# EAGLE board Resistor_Resistor (EAGLE 8.3.0), part 17 of 32
## Placement (x,y rotation side) (continued)
R20483  10K  [0201]  149.71,51.26 0 top
R20484  10K  [0201]  149.71,51.87 0 top
R20485  10K  [0201]  149.71,52.48 0 top
R20486  10K  [0201]  149.71,53.09 0 top
R20487  10K  [0201]  149.71,53.7 0 top
R20488  10K  [0201]  149.71,54.31 0 top
R20489  10K  [0201]  149.71,54.91 0 top
R20490  10K  [0201]  149.71,55.52 0 top
R20491  10K  [0201]  149.71,56.13 0 top
R20492  10K  [0201]  149.71,56.74 0 top
R20493  10K  [0201]  149.71,57.35 0 top
R20494  10K  [0201]  149.71,57.96 0 top
R20495  10K  [0201]  149.71,58.57 0 top
R20496  10K  [0201]  149.71,59.18 0 top
R20497  10K  [0201]  149.71,59.79 0 top
R20498  10K  [0201]  149.71,60.4 0 top
R20499  10K  [0201]  149.71,61.01 0 top
R20500  10K  [0201]  149.71,61.62 0 top
R20501  10K  [0201]  149.71,62.23 0 top
R20502  10K  [0201]  149.71,62.84 0 top
R20503  10K  [0201]  149.71,63.45 0 top
R20504  10K  [0201]  149.71,64.06 0 top
R20505  10K  [0201]  149.71,64.67 0 top
R20506  10K  [0201]  149.71,65.28 0 top
R20507  10K  [0201]  149.71,65.89 0 top
R20508  10K  [0201]  149.71,66.5 0 top
R20509  10K  [0201]  149.71,67.11 0 top
R20510  10K  [0201]  149.71,67.72 0 top
R20511  10K  [0201]  149.71,68.33 0 top
R20512  10K  [0201]  149.71,68.94 0 top
R20513  10K  [0201]  149.71,69.55 0 top
R20514  10K  [0201]  149.71,70.15 0 top
R20515  10K  [0201]  149.71,70.76 0 top
R20516  10K  [0201]  149.71,71.37 0 top
R20517  10K  [0201]  149.71,71.98 0 top
R20518  10K  [0201]  149.71,72.59 0 top
R20519  10K  [0201]  149.71,73.2 0 top
R20520  10K  [0201]  149.71,73.81 0 top
R20521  10K  [0201]  149.71,74.42 0 top
R20522  10K  [0201]  149.71,75.03 0 top
R20523  10K  [0201]  149.71,75.64 0 top
R20524  10K  [0201]  149.71,76.25 0 top
R20525  10K  [0201]  149.71,76.86 0 top
R20526  10K  [0201]  149.71,77.47 0 top
R20527  10K  [0201]  149.71,78.08 0 top
R20528  10K  [0201]  149.71,78.69 0 top
R20529  10K  [0201]  149.71,79.3 0 top
R20530  10K  [0201]  149.71,79.91 0 top
R20531  10K  [0201]  149.71,80.52 0 top
R20532  10K  [0201]  149.71,81.13 0 top
R20533  10K  [0201]  149.71,81.74 0 top
R20534  10K  [0201]  149.71,82.35 0 top
R20535  10K  [0201]  149.71,82.96 0 top
R20536  10K  [0201]  149.71,83.57 0 top
R20537  10K  [0201]  149.71,84.18 0 top
R20538  10K  [0201]  149.71,84.79 0 top
R20539  10K  [0201]  149.71,85.39 0 top
R20540  10K  [0201]  149.71,86 0 top
R20541  10K  [0201]  149.71,86.61 0 top
R20542  10K  [0201]  149.71,87.22 0 top
R20543  10K  [0201]  149.71,87.83 0 top
R20544  10K  [0201]  149.71,88.44 0 top
R20545  10K  [0201]  149.71,89.05 0 top
R20546  10K  [0201]  149.71,89.66 0 top
R20547  10K  [0201]  149.71,90.27 0 top
R20548  10K  [0201]  149.71,90.88 0 top
R20549  10K  [0201]  149.71,91.49 0 top
R20550  10K  [0201]  149.71,92.1 0 top
R20551  10K  [0201]  149.71,92.71 0 top
R20552  10K  [0201]  149.71,93.32 0 top
R20553  10K  [0201]  149.71,93.93 0 top
R20554  10K  [0201]  149.71,94.54 0 top
R20555  10K  [0201]  149.71,95.15 0 top
R20556  10K  [0201]  149.71,95.76 0 top
R20557  10K  [0201]  149.71,96.37 0 top
R20558  10K  [0201]  149.71,96.98 0 top
R20559  10K  [0201]  149.71,97.59 0 top
R20560  10K  [0201]  149.71,98.2 0 top
R20561  10K  [0201]  149.71,98.81 0 top
R20562  10K  [0201]  149.71,99.42 0 top
R20563  10K  [0201]  149.71,100.03 0 top
R20564  10K  [0201]  149.71,100.63 0 top
R20565  10K  [0201]  149.71,101.24 0 top
R20566  10K  [0201]  149.71,101.85 0 top
R20567  10K  [0201]  149.71,102.46 0 top
R20568  10K  [0201]  149.71,103.07 0 top
R20569  10K  [0201]  149.71,103.68 0 top
R20570  10K  [0201]  149.71,104.29 0 top
R20571  10K  [0201]  149.71,104.9 0 top
R20572  10K  [0201]  149.71,105.51 0 top
R20573  10K  [0201]  149.71,106.12 0 top
R20574  10K  [0201]  149.71,106.73 0 top
R20575  10K  [0201]  149.71,107.34 0 top
R20576  10K  [0201]  149.71,107.95 0 top
R20577  10K  [0201]  149.71,108.56 0 top
R20578  10K  [0201]  149.71,109.17 0 top
R20579  10K  [0201]  149.71,109.78 0 top
R20580  10K  [0201]  149.71,110.39 0 top
R20581  10K  [0201]  149.71,111 0 top
R20582  10K  [0201]  149.71,111.61 0 top
R20583  10K  [0201]  149.71,112.22 0 top
R20584  10K  [0201]  149.71,112.83 0 top
R20585  10K  [0201]  149.71,113.44 0 top
R20586  10K  [0201]  149.71,114.05 0 top
R20587  10K  [0201]  149.71,114.66 0 top
R20588  10K  [0201]  149.71,115.27 0 top
R20589  10K  [0201]  149.71,115.87 0 top
R20590  10K  [0201]  149.71,116.48 0 top
R20591  10K  [0201]  149.71,117.09 0 top
R20592  10K  [0201]  149.71,117.7 0 top
R20593  10K  [0201]  149.71,118.31 0 top
R20594  10K  [0201]  149.71,118.92 0 top
R20595  10K  [0201]  149.71,119.53 0 top
R20596  10K  [0201]  149.71,120.14 0 top
R20597  10K  [0201]  149.71,120.75 0 top
R20598  10K  [0201]  149.71,121.36 0 top
R20599  10K  [0201]  149.71,121.97 0 top
R20600  10K  [0201]  149.71,122.58 0 top
R20601  10K  [0201]  150.93,1.27 0 top
R20602  10K  [0201]  150.93,1.88 0 top
R20603  10K  [0201]  150.93,2.49 0 top
R20604  10K  [0201]  150.93,3.1 0 top
R20605  10K  [0201]  150.93,3.71 0 top
R20606  10K  [0201]  150.93,4.32 0 top
R20607  10K  [0201]  150.93,4.93 0 top
R20608  10K  [0201]  150.93,5.54 0 top
R20609  10K  [0201]  150.93,6.15 0 top
R20610  10K  [0201]  150.93,6.76 0 top
R20611  10K  [0201]  150.93,7.37 0 top
R20612  10K  [0201]  150.93,7.98 0 top
R20613  10K  [0201]  150.93,8.59 0 top
R20614  10K  [0201]  150.93,9.19 0 top
R20615  10K  [0201]  150.93,9.8 0 top
R20616  10K  [0201]  150.93,10.41 0 top
R20617  10K  [0201]  150.93,11.02 0 top
R20618  10K  [0201]  150.93,11.63 0 top
R20619  10K  [0201]  150.93,12.24 0 top
R20620  10K  [0201]  150.93,12.85 0 top
R20621  10K  [0201]  150.93,13.46 0 top
R20622  10K  [0201]  150.93,14.07 0 top
R20623  10K  [0201]  150.93,14.68 0 top
R20624  10K  [0201]  150.93,15.29 0 top
R20625  10K  [0201]  150.93,15.9 0 top
R20626  10K  [0201]  150.93,16.51 0 top
R20627  10K  [0201]  150.93,17.12 0 top
R20628  10K  [0201]  150.93,17.73 0 top
R20629  10K  [0201]  150.93,18.34 0 top
R20630  10K  [0201]  150.93,18.95 0 top
R20631  10K  [0201]  150.93,19.56 0 top
R20632  10K  [0201]  150.93,20.17 0 top
R20633  10K  [0201]  150.93,20.78 0 top
R20634  10K  [0201]  150.93,21.39 0 top
R20635  10K  [0201]  150.93,22 0 top
R20636  10K  [0201]  150.93,22.61 0 top
R20637  10K  [0201]  150.93,23.22 0 top
R20638  10K  [0201]  150.93,23.83 0 top
R20639  10K  [0201]  150.93,24.43 0 top
R20640  10K  [0201]  150.93,25.04 0 top
R20641  10K  [0201]  150.93,25.65 0 top
R20642  10K  [0201]  150.93,26.26 0 top
R20643  10K  [0201]  150.93,26.87 0 top
R20644  10K  [0201]  150.93,27.48 0 top
R20645  10K  [0201]  150.93,28.09 0 top
R20646  10K  [0201]  150.93,28.7 0 top
R20647  10K  [0201]  150.93,29.31 0 top
R20648  10K  [0201]  150.93,29.92 0 top
R20649  10K  [0201]  150.93,30.53 0 top
R20650  10K  [0201]  150.93,31.14 0 top
R20651  10K  [0201]  150.93,31.75 0 top
R20652  10K  [0201]  150.93,32.36 0 top
R20653  10K  [0201]  150.93,32.97 0 top
R20654  10K  [0201]  150.93,33.58 0 top
R20655  10K  [0201]  150.93,34.19 0 top
R20656  10K  [0201]  150.93,34.8 0 top
R20657  10K  [0201]  150.93,35.41 0 top
R20658  10K  [0201]  150.93,36.02 0 top
R20659  10K  [0201]  150.93,36.63 0 top
R20660  10K  [0201]  150.93,37.24 0 top
R20661  10K  [0201]  150.93,37.85 0 top
R20662  10K  [0201]  150.93,38.46 0 top
R20663  10K  [0201]  150.93,39.07 0 top
R20664  10K  [0201]  150.93,39.67 0 top
R20665  10K  [0201]  150.93,40.28 0 top
R20666  10K  [0201]  150.93,40.89 0 top
R20667  10K  [0201]  150.93,41.5 0 top
R20668  10K  [0201]  150.93,42.11 0 top
R20669  10K  [0201]  150.93,42.72 0 top
R20670  10K  [0201]  150.93,43.33 0 top
R20671  10K  [0201]  150.93,43.94 0 top
R20672  10K  [0201]  150.93,44.55 0 top
R20673  10K  [0201]  150.93,45.16 0 top
R20674  10K  [0201]  150.93,45.77 0 top
R20675  10K  [0201]  150.93,46.38 0 top
R20676  10K  [0201]  150.93,46.99 0 top
R20677  10K  [0201]  150.93,47.6 0 top
R20678  10K  [0201]  150.93,48.21 0 top
R20679  10K  [0201]  150.93,48.82 0 top
R20680  10K  [0201]  150.93,49.43 0 top
R20681  10K  [0201]  150.93,50.04 0 top
R20682  10K  [0201]  150.93,50.65 0 top
R20683  10K  [0201]  150.93,51.26 0 top
R20684  10K  [0201]  150.93,51.87 0 top
R20685  10K  [0201]  150.93,52.48 0 top
R20686  10K  [0201]  150.93,53.09 0 top
R20687  10K  [0201]  150.93,53.7 0 top
R20688  10K  [0201]  150.93,54.31 0 top
R20689  10K  [0201]  150.93,54.91 0 top
R20690  10K  [0201]  150.93,55.52 0 top
R20691  10K  [0201]  150.93,56.13 0 top
R20692  10K  [0201]  150.93,56.74 0 top
R20693  10K  [0201]  150.93,57.35 0 top
R20694  10K  [0201]  150.93,57.96 0 top
R20695  10K  [0201]  150.93,58.57 0 top
R20696  10K  [0201]  150.93,59.18 0 top
R20697  10K  [0201]  150.93,59.79 0 top
R20698  10K  [0201]  150.93,60.4 0 top
R20699  10K  [0201]  150.93,61.01 0 top
R20700  10K  [0201]  150.93,61.62 0 top
R20701  10K  [0201]  150.93,62.23 0 top
R20702  10K  [0201]  150.93,62.84 0 top
R20703  10K  [0201]  150.93,63.45 0 top
R20704  10K  [0201]  150.93,64.06 0 top
R20705  10K  [0201]  150.93,64.67 0 top
R20706  10K  [0201]  150.93,65.28 0 top
R20707  10K  [0201]  150.93,65.89 0 top
R20708  10K  [0201]  150.93,66.5 0 top
R20709  10K  [0201]  150.93,67.11 0 top
R20710  10K  [0201]  150.93,67.72 0 top
R20711  10K  [0201]  150.93,68.33 0 top
R20712  10K  [0201]  150.93,68.94 0 top
R20713  10K  [0201]  150.93,69.55 0 top
R20714  10K  [0201]  150.93,70.15 0 top
R20715  10K  [0201]  150.93,70.76 0 top
R20716  10K  [0201]  150.93,71.37 0 top
R20717  10K  [0201]  150.93,71.98 0 top
R20718  10K  [0201]  150.93,72.59 0 top
R20719  10K  [0201]  150.93,73.2 0 top
R20720  10K  [0201]  150.93,73.81 0 top
R20721  10K  [0201]  150.93,74.42 0 top
R20722  10K  [0201]  150.93,75.03 0 top
R20723  10K  [0201]  150.93,75.64 0 top
R20724  10K  [0201]  150.93,76.25 0 top
R20725  10K  [0201]  150.93,76.86 0 top
R20726  10K  [0201]  150.93,77.47 0 top
R20727  10K  [0201]  150.93,78.08 0 top
R20728  10K  [0201]  150.93,78.69 0 top
R20729  10K  [0201]  150.93,79.3 0 top
R20730  10K  [0201]  150.93,79.91 0 top
R20731  10K  [0201]  150.93,80.52 0 top
R20732  10K  [0201]  150.93,81.13 0 top
R20733  10K  [0201]  150.93,81.74 0 top
R20734  10K  [0201]  150.93,82.35 0 top
R20735  10K  [0201]  150.93,82.96 0 top
R20736  10K  [0201]  150.93,83.57 0 top
R20737  10K  [0201]  150.93,84.18 0 top
R20738  10K  [0201]  150.93,84.79 0 top
R20739  10K  [0201]  150.93,85.39 0 top
R20740  10K  [0201]  150.93,86 0 top
R20741  10K  [0201]  150.93,86.61 0 top
R20742  10K  [0201]  150.93,87.22 0 top
R20743  10K  [0201]  150.93,87.83 0 top
R20744  10K  [0201]  150.93,88.44 0 top
R20745  10K  [0201]  150.93,89.05 0 top
R20746  10K  [0201]  150.93,89.66 0 top
R20747  10K  [0201]  150.93,90.27 0 top
R20748  10K  [0201]  150.93,90.88 0 top
R20749  10K  [0201]  150.93,91.49 0 top
R20750  10K  [0201]  150.93,92.1 0 top
R20751  10K  [0201]  150.93,92.71 0 top
R20752  10K  [0201]  150.93,93.32 0 top
R20753  10K  [0201]  150.93,93.93 0 top
R20754  10K  [0201]  150.93,94.54 0 top
R20755  10K  [0201]  150.93,95.15 0 top
R20756  10K  [0201]  150.93,95.76 0 top
R20757  10K  [0201]  150.93,96.37 0 top
R20758  10K  [0201]  150.93,96.98 0 top
R20759  10K  [0201]  150.93,97.59 0 top
R20760  10K  [0201]  150.93,98.2 0 top
R20761  10K  [0201]  150.93,98.81 0 top
R20762  10K  [0201]  150.93,99.42 0 top
R20763  10K  [0201]  150.93,100.03 0 top
R20764  10K  [0201]  150.93,100.63 0 top
R20765  10K  [0201]  150.93,101.24 0 top
R20766  10K  [0201]  150.93,101.85 0 top
R20767  10K  [0201]  150.93,102.46 0 top
R20768  10K  [0201]  150.93,103.07 0 top
R20769  10K  [0201]  150.93,103.68 0 top
R20770  10K  [0201]  150.93,104.29 0 top
R20771  10K  [0201]  150.93,104.9 0 top
R20772  10K  [0201]  150.93,105.51 0 top
R20773  10K  [0201]  150.93,106.12 0 top
R20774  10K  [0201]  150.93,106.73 0 top
R20775  10K  [0201]  150.93,107.34 0 top
R20776  10K  [0201]  150.93,107.95 0 top
R20777  10K  [0201]  150.93,108.56 0 top
R20778  10K  [0201]  150.93,109.17 0 top
R20779  10K  [0201]  150.93,109.78 0 top
R20780  10K  [0201]  150.93,110.39 0 top
R20781  10K  [0201]  150.93,111 0 top
R20782  10K  [0201]  150.93,111.61 0 top
R20783  10K  [0201]  150.93,112.22 0 top
R20784  10K  [0201]  150.93,112.83 0 top
R20785  10K  [0201]  150.93,113.44 0 top
R20786  10K  [0201]  150.93,114.05 0 top
R20787  10K  [0201]  150.93,114.66 0 top
R20788  10K  [0201]  150.93,115.27 0 top
R20789  10K  [0201]  150.93,115.87 0 top
R20790  10K  [0201]  150.93,116.48 0 top
R20791  10K  [0201]  150.93,117.09 0 top
R20792  10K  [0201]  150.93,117.7 0 top
R20793  10K  [0201]  150.93,118.31 0 top
R20794  10K  [0201]  150.93,118.92 0 top
R20795  10K  [0201]  150.93,119.53 0 top
R20796  10K  [0201]  150.93,120.14 0 top
R20797  10K  [0201]  150.93,120.75 0 top
R20798  10K  [0201]  150.93,121.36 0 top
R20799  10K  [0201]  150.93,121.97 0 top
R20800  10K  [0201]  150.93,122.58 0 top
R20801  10K  [0201]  152.15,1.27 0 top
R20802  10K  [0201]  152.15,1.88 0 top
R20803  10K  [0201]  152.15,2.49 0 top
R20804  10K  [0201]  152.15,3.1 0 top
R20805  10K  [0201]  152.15,3.71 0 top
R20806  10K  [0201]  152.15,4.32 0 top
R20807  10K  [0201]  152.15,4.93 0 top
R20808  10K  [0201]  152.15,5.54 0 top
R20809  10K  [0201]  152.15,6.15 0 top
R20810  10K  [0201]  152.15,6.76 0 top
R20811  10K  [0201]  152.15,7.37 0 top
R20812  10K  [0201]  152.15,7.98 0 top
R20813  10K  [0201]  152.15,8.59 0 top
R20814  10K  [0201]  152.15,9.19 0 top
R20815  10K  [0201]  152.15,9.8 0 top
R20816  10K  [0201]  152.15,10.41 0 top
R20817  10K  [0201]  152.15,11.02 0 top
R20818  10K  [0201]  152.15,11.63 0 top
R20819  10K  [0201]  152.15,12.24 0 top
R20820  10K  [0201]  152.15,12.85 0 top
R20821  10K  [0201]  152.15,13.46 0 top
R20822  10K  [0201]  152.15,14.07 0 top
R20823  10K  [0201]  152.15,14.68 0 top
R20824  10K  [0201]  152.15,15.29 0 top
R20825  10K  [0201]  152.15,15.9 0 top
R20826  10K  [0201]  152.15,16.51 0 top
R20827  10K  [0201]  152.15,17.12 0 top
R20828  10K  [0201]  152.15,17.73 0 top
R20829  10K  [0201]  152.15,18.34 0 top
R20830  10K  [0201]  152.15,18.95 0 top
R20831  10K  [0201]  152.15,19.56 0 top
R20832  10K  [0201]  152.15,20.17 0 top
R20833  10K  [0201]  152.15,20.78 0 top
R20834  10K  [0201]  152.15,21.39 0 top
R20835  10K  [0201]  152.15,22 0 top
R20836  10K  [0201]  152.15,22.61 0 top
R20837  10K  [0201]  152.15,23.22 0 top
R20838  10K  [0201]  152.15,23.83 0 top
R20839  10K  [0201]  152.15,24.43 0 top
R20840  10K  [0201]  152.15,25.04 0 top
R20841  10K  [0201]  152.15,25.65 0 top
R20842  10K  [0201]  152.15,26.26 0 top
R20843  10K  [0201]  152.15,26.87 0 top
R20844  10K  [0201]  152.15,27.48 0 top
R20845  10K  [0201]  152.15,28.09 0 top
R20846  10K  [0201]  152.15,28.7 0 top
R20847  10K  [0201]  152.15,29.31 0 top
R20848  10K  [0201]  152.15,29.92 0 top
R20849  10K  [0201]  152.15,30.53 0 top
R20850  10K  [0201]  152.15,31.14 0 top
R20851  10K  [0201]  152.15,31.75 0 top
R20852  10K  [0201]  152.15,32.36 0 top
R20853  10K  [0201]  152.15,32.97 0 top
R20854  10K  [0201]  152.15,33.58 0 top
R20855  10K  [0201]  152.15,34.19 0 top
R20856  10K  [0201]  152.15,34.8 0 top
R20857  10K  [0201]  152.15,35.41 0 top
R20858  10K  [0201]  152.15,36.02 0 top
R20859  10K  [0201]  152.15,36.63 0 top
R20860  10K  [0201]  152.15,37.24 0 top
R20861  10K  [0201]  152.15,37.85 0 top
R20862  10K  [0201]  152.15,38.46 0 top
R20863  10K  [0201]  152.15,39.07 0 top
R20864  10K  [0201]  152.15,39.67 0 top
R20865  10K  [0201]  152.15,40.28 0 top
R20866  10K  [0201]  152.15,40.89 0 top
R20867  10K  [0201]  152.15,41.5 0 top
R20868  10K  [0201]  152.15,42.11 0 top
R20869  10K  [0201]  152.15,42.72 0 top
R20870  10K  [0201]  152.15,43.33 0 top
R20871  10K  [0201]  152.15,43.94 0 top
R20872  10K  [0201]  152.15,44.55 0 top
R20873  10K  [0201]  152.15,45.16 0 top
R20874  10K  [0201]  152.15,45.77 0 top
R20875  10K  [0201]  152.15,46.38 0 top
R20876  10K  [0201]  152.15,46.99 0 top
R20877  10K  [0201]  152.15,47.6 0 top
R20878  10K  [0201]  152.15,48.21 0 top
R20879  10K  [0201]  152.15,48.82 0 top
R20880  10K  [0201]  152.15,49.43 0 top
R20881  10K  [0201]  152.15,50.04 0 top
R20882  10K  [0201]  152.15,50.65 0 top
R20883  10K  [0201]  152.15,51.26 0 top
R20884  10K  [0201]  152.15,51.87 0 top
R20885  10K  [0201]  152.15,52.48 0 top
R20886  10K  [0201]  152.15,53.09 0 top
R20887  10K  [0201]  152.15,53.7 0 top
R20888  10K  [0201]  152.15,54.31 0 top
R20889  10K  [0201]  152.15,54.91 0 top
R20890  10K  [0201]  152.15,55.52 0 top
R20891  10K  [0201]  152.15,56.13 0 top
R20892  10K  [0201]  152.15,56.74 0 top
R20893  10K  [0201]  152.15,57.35 0 top
R20894  10K  [0201]  152.15,57.96 0 top
R20895  10K  [0201]  152.15,58.57 0 top
R20896  10K  [0201]  152.15,59.18 0 top
R20897  10K  [0201]  152.15,59.79 0 top
R20898  10K  [0201]  152.15,60.4 0 top
R20899  10K  [0201]  152.15,61.01 0 top
R20900  10K  [0201]  152.15,61.62 0 top
R20901  10K  [0201]  152.15,62.23 0 top
R20902  10K  [0201]  152.15,62.84 0 top
R20903  10K  [0201]  152.15,63.45 0 top
R20904  10K  [0201]  152.15,64.06 0 top
R20905  10K  [0201]  152.15,64.67 0 top
R20906  10K  [0201]  152.15,65.28 0 top
R20907  10K  [0201]  152.15,65.89 0 top
R20908  10K  [0201]  152.15,66.5 0 top
R20909  10K  [0201]  152.15,67.11 0 top
R20910  10K  [0201]  152.15,67.72 0 top
R20911  10K  [0201]  152.15,68.33 0 top
R20912  10K  [0201]  152.15,68.94 0 top
R20913  10K  [0201]  152.15,69.55 0 top
R20914  10K  [0201]  152.15,70.15 0 top
R20915  10K  [0201]  152.15,70.76 0 top
R20916  10K  [0201]  152.15,71.37 0 top
R20917  10K  [0201]  152.15,71.98 0 top
R20918  10K  [0201]  152.15,72.59 0 top
R20919  10K  [0201]  152.15,73.2 0 top
R20920  10K  [0201]  152.15,73.81 0 top
R20921  10K  [0201]  152.15,74.42 0 top
R20922  10K  [0201]  152.15,75.03 0 top
R20923  10K  [0201]  152.15,75.64 0 top
R20924  10K  [0201]  152.15,76.25 0 top
R20925  10K  [0201]  152.15,76.86 0 top
R20926  10K  [0201]  152.15,77.47 0 top
R20927  10K  [0201]  152.15,78.08 0 top
R20928  10K  [0201]  152.15,78.69 0 top
R20929  10K  [0201]  152.15,79.3 0 top
R20930  10K  [0201]  152.15,79.91 0 top
R20931  10K  [0201]  152.15,80.52 0 top
R20932  10K  [0201]  152.15,81.13 0 top
R20933  10K  [0201]  152.15,81.74 0 top
R20934  10K  [0201]  152.15,82.35 0 top
R20935  10K  [0201]  152.15,82.96 0 top
R20936  10K  [0201]  152.15,83.57 0 top
R20937  10K  [0201]  152.15,84.18 0 top
R20938  10K  [0201]  152.15,84.79 0 top
R20939  10K  [0201]  152.15,85.39 0 top
R20940  10K  [0201]  152.15,86 0 top
R20941  10K  [0201]  152.15,86.61 0 top
R20942  10K  [0201]  152.15,87.22 0 top
R20943  10K  [0201]  152.15,87.83 0 top
R20944  10K  [0201]  152.15,88.44 0 top
R20945  10K  [0201]  152.15,89.05 0 top
R20946  10K  [0201]  152.15,89.66 0 top
R20947  10K  [0201]  152.15,90.27 0 top
R20948  10K  [0201]  152.15,90.88 0 top
R20949  10K  [0201]  152.15,91.49 0 top
R20950  10K  [0201]  152.15,92.1 0 top
R20951  10K  [0201]  152.15,92.71 0 top
R20952  10K  [0201]  152.15,93.32 0 top
R20953  10K  [0201]  152.15,93.93 0 top
R20954  10K  [0201]  152.15,94.54 0 top
R20955  10K  [0201]  152.15,95.15 0 top
R20956  10K  [0201]  152.15,95.76 0 top
R20957  10K  [0201]  152.15,96.37 0 top
R20958  10K  [0201]  152.15,96.98 0 top
R20959  10K  [0201]  152.15,97.59 0 top
R20960  10K  [0201]  152.15,98.2 0 top
R20961  10K  [0201]  152.15,98.81 0 top
R20962  10K  [0201]  152.15,99.42 0 top
R20963  10K  [0201]  152.15,100.03 0 top
R20964  10K  [0201]  152.15,100.63 0 top
R20965  10K  [0201]  152.15,101.24 0 top
R20966  10K  [0201]  152.15,101.85 0 top
R20967  10K  [0201]  152.15,102.46 0 top
R20968  10K  [0201]  152.15,103.07 0 top
R20969  10K  [0201]  152.15,103.68 0 top
R20970  10K  [0201]  152.15,104.29 0 top
R20971  10K  [0201]  152.15,104.9 0 top
R20972  10K  [0201]  152.15,105.51 0 top
R20973  10K  [0201]  152.15,106.12 0 top
R20974  10K  [0201]  152.15,106.73 0 top
R20975  10K  [0201]  152.15,107.34 0 top
R20976  10K  [0201]  152.15,107.95 0 top
R20977  10K  [0201]  152.15,108.56 0 top
R20978  10K  [0201]  152.15,109.17 0 top
R20979  10K  [0201]  152.15,109.78 0 top
R20980  10K  [0201]  152.15,110.39 0 top
R20981  10K  [0201]  152.15,111 0 top
R20982  10K  [0201]  152.15,111.61 0 top
R20983  10K  [0201]  152.15,112.22 0 top
R20984  10K  [0201]  152.15,112.83 0 top
R20985  10K  [0201]  152.15,113.44 0 top
R20986  10K  [0201]  152.15,114.05 0 top
R20987  10K  [0201]  152.15,114.66 0 top
R20988  10K  [0201]  152.15,115.27 0 top
R20989  10K  [0201]  152.15,115.87 0 top
R20990  10K  [0201]  152.15,116.48 0 top
R20991  10K  [0201]  152.15,117.09 0 top
R20992  10K  [0201]  152.15,117.7 0 top
R20993  10K  [0201]  152.15,118.31 0 top
R20994  10K  [0201]  152.15,118.92 0 top
R20995  10K  [0201]  152.15,119.53 0 top
R20996  10K  [0201]  152.15,120.14 0 top
R20997  10K  [0201]  152.15,120.75 0 top
R20998  10K  [0201]  152.15,121.36 0 top
R20999  10K  [0201]  152.15,121.97 0 top
R21000  10K  [0201]  152.15,122.58 0 top
R21001  10K  [0201]  153.37,1.27 0 top
R21002  10K  [0201]  153.37,1.88 0 top
R21003  10K  [0201]  153.37,2.49 0 top
R21004  10K  [0201]  153.37,3.1 0 top
R21005  10K  [0201]  153.37,3.71 0 top
R21006  10K  [0201]  153.37,4.32 0 top
R21007  10K  [0201]  153.37,4.93 0 top
R21008  10K  [0201]  153.37,5.54 0 top
R21009  10K  [0201]  153.37,6.15 0 top
R21010  10K  [0201]  153.37,6.76 0 top
R21011  10K  [0201]  153.37,7.37 0 top
R21012  10K  [0201]  153.37,7.98 0 top
R21013  10K  [0201]  153.37,8.59 0 top
R21014  10K  [0201]  153.37,9.19 0 top
R21015  10K  [0201]  153.37,9.8 0 top
R21016  10K  [0201]  153.37,10.41 0 top
R21017  10K  [0201]  153.37,11.02 0 top
R21018  10K  [0201]  153.37,11.63 0 top
R21019  10K  [0201]  153.37,12.24 0 top
R21020  10K  [0201]  153.37,12.85 0 top
R21021  10K  [0201]  153.37,13.46 0 top
R21022  10K  [0201]  153.37,14.07 0 top
R21023  10K  [0201]  153.37,14.68 0 top
R21024  10K  [0201]  153.37,15.29 0 top
R21025  10K  [0201]  153.37,15.9 0 top
R21026  10K  [0201]  153.37,16.51 0 top
R21027  10K  [0201]  153.37,17.12 0 top
R21028  10K  [0201]  153.37,17.73 0 top
R21029  10K  [0201]  153.37,18.34 0 top
R21030  10K  [0201]  153.37,18.95 0 top
R21031  10K  [0201]  153.37,19.56 0 top
R21032  10K  [0201]  153.37,20.17 0 top
R21033  10K  [0201]  153.37,20.78 0 top
R21034  10K  [0201]  153.37,21.39 0 top
R21035  10K  [0201]  153.37,22 0 top
R21036  10K  [0201]  153.37,22.61 0 top
R21037  10K  [0201]  153.37,23.22 0 top
R21038  10K  [0201]  153.37,23.83 0 top
R21039  10K  [0201]  153.37,24.43 0 top
R21040  10K  [0201]  153.37,25.04 0 top
R21041  10K  [0201]  153.37,25.65 0 top
R21042  10K  [0201]  153.37,26.26 0 top
R21043  10K  [0201]  153.37,26.87 0 top
R21044  10K  [0201]  153.37,27.48 0 top
R21045  10K  [0201]  153.37,28.09 0 top
R21046  10K  [0201]  153.37,28.7 0 top
R21047  10K  [0201]  153.37,29.31 0 top
R21048  10K  [0201]  153.37,29.92 0 top
R21049  10K  [0201]  153.37,30.53 0 top
R21050  10K  [0201]  153.37,31.14 0 top
R21051  10K  [0201]  153.37,31.75 0 top
R21052  10K  [0201]  153.37,32.36 0 top
R21053  10K  [0201]  153.37,32.97 0 top
R21054  10K  [0201]  153.37,33.58 0 top
R21055  10K  [0201]  153.37,34.19 0 top
R21056  10K  [0201]  153.37,34.8 0 top
R21057  10K  [0201]  153.37,35.41 0 top
R21058  10K  [0201]  153.37,36.02 0 top
R21059  10K  [0201]  153.37,36.63 0 top
R21060  10K  [0201]  153.37,37.24 0 top
R21061  10K  [0201]  153.37,37.85 0 top
R21062  10K  [0201]  153.37,38.46 0 top
R21063  10K  [0201]  153.37,39.07 0 top
R21064  10K  [0201]  153.37,39.67 0 top
R21065  10K  [0201]  153.37,40.28 0 top
R21066  10K  [0201]  153.37,40.89 0 top
R21067  10K  [0201]  153.37,41.5 0 top
R21068  10K  [0201]  153.37,42.11 0 top
R21069  10K  [0201]  153.37,42.72 0 top
R21070  10K  [0201]  153.37,43.33 0 top
R21071  10K  [0201]  153.37,43.94 0 top
R21072  10K  [0201]  153.37,44.55 0 top
R21073  10K  [0201]  153.37,45.16 0 top
R21074  10K  [0201]  153.37,45.77 0 top
R21075  10K  [0201]  153.37,46.38 0 top
R21076  10K  [0201]  153.37,46.99 0 top
R21077  10K  [0201]  153.37,47.6 0 top
R21078  10K  [0201]  153.37,48.21 0 top
R21079  10K  [0201]  153.37,48.82 0 top
R21080  10K  [0201]  153.37,49.43 0 top
R21081  10K  [0201]  153.37,50.04 0 top
R21082  10K  [0201]  153.37,50.65 0 top
R21083  10K  [0201]  153.37,51.26 0 top
R21084  10K  [0201]  153.37,51.87 0 top
R21085  10K  [0201]  153.37,52.48 0 top
R21086  10K  [0201]  153.37,53.09 0 top
R21087  10K  [0201]  153.37,53.7 0 top
R21088  10K  [0201]  153.37,54.31 0 top
R21089  10K  [0201]  153.37,54.91 0 top
R21090  10K  [0201]  153.37,55.52 0 top
R21091  10K  [0201]  153.37,56.13 0 top
R21092  10K  [0201]  153.37,56.74 0 top
R21093  10K  [0201]  153.37,57.35 0 top
R21094  10K  [0201]  153.37,57.96 0 top
R21095  10K  [0201]  153.37,58.57 0 top
R21096  10K  [0201]  153.37,59.18 0 top
R21097  10K  [0201]  153.37,59.79 0 top
R21098  10K  [0201]  153.37,60.4 0 top
R21099  10K  [0201]  153.37,61.01 0 top
R21100  10K  [0201]  153.37,61.62 0 top
R21101  10K  [0201]  153.37,62.23 0 top
R21102  10K  [0201]  153.37,62.84 0 top
R21103  10K  [0201]  153.37,63.45 0 top
R21104  10K  [0201]  153.37,64.06 0 top
R21105  10K  [0201]  153.37,64.67 0 top
R21106  10K  [0201]  153.37,65.28 0 top
R21107  10K  [0201]  153.37,65.89 0 top
R21108  10K  [0201]  153.37,66.5 0 top
R21109  10K  [0201]  153.37,67.11 0 top
R21110  10K  [0201]  153.37,67.72 0 top
R21111  10K  [0201]  153.37,68.33 0 top
R21112  10K  [0201]  153.37,68.94 0 top
R21113  10K  [0201]  153.37,69.55 0 top
R21114  10K  [0201]  153.37,70.15 0 top
R21115  10K  [0201]  153.37,70.76 0 top
R21116  10K  [0201]  153.37,71.37 0 top
R21117  10K  [0201]  153.37,71.98 0 top
R21118  10K  [0201]  153.37,72.59 0 top
R21119  10K  [0201]  153.37,73.2 0 top
R21120  10K  [0201]  153.37,73.81 0 top
R21121  10K  [0201]  153.37,74.42 0 top
R21122  10K  [0201]  153.37,75.03 0 top
R21123  10K  [0201]  153.37,75.64 0 top
R21124  10K  [0201]  153.37,76.25 0 top
R21125  10K  [0201]  153.37,76.86 0 top
R21126  10K  [0201]  153.37,77.47 0 top
R21127  10K  [0201]  153.37,78.08 0 top
R21128  10K  [0201]  153.37,78.69 0 top
R21129  10K  [0201]  153.37,79.3 0 top
R21130  10K  [0201]  153.37,79.91 0 top
R21131  10K  [0201]  153.37,80.52 0 top
R21132  10K  [0201]  153.37,81.13 0 top
R21133  10K  [0201]  153.37,81.74 0 top
R21134  10K  [0201]  153.37,82.35 0 top
R21135  10K  [0201]  153.37,82.96 0 top
R21136  10K  [0201]  153.37,83.57 0 top
R21137  10K  [0201]  153.37,84.18 0 top
R21138  10K  [0201]  153.37,84.79 0 top
R21139  10K  [0201]  153.37,85.39 0 top
R21140  10K  [0201]  153.37,86 0 top
R21141  10K  [0201]  153.37,86.61 0 top
R21142  10K  [0201]  153.37,87.22 0 top
R21143  10K  [0201]  153.37,87.83 0 top
R21144  10K  [0201]  153.37,88.44 0 top
R21145  10K  [0201]  153.37,89.05 0 top
R21146  10K  [0201]  153.37,89.66 0 top
R21147  10K  [0201]  153.37,90.27 0 top
R21148  10K  [0201]  153.37,90.88 0 top
R21149  10K  [0201]  153.37,91.49 0 top
R21150  10K  [0201]  153.37,92.1 0 top
R21151  10K  [0201]  153.37,92.71 0 top
R21152  10K  [0201]  153.37,93.32 0 top
R21153  10K  [0201]  153.37,93.93 0 top
R21154  10K  [0201]  153.37,94.54 0 top
R21155  10K  [0201]  153.37,95.15 0 top
R21156  10K  [0201]  153.37,95.76 0 top
R21157  10K  [0201]  153.37,96.37 0 top
R21158  10K  [0201]  153.37,96.98 0 top
R21159  10K  [0201]  153.37,97.59 0 top
R21160  10K  [0201]  153.37,98.2 0 top
R21161  10K  [0201]  153.37,98.81 0 top
R21162  10K  [0201]  153.37,99.42 0 top
R21163  10K  [0201]  153.37,100.03 0 top
R21164  10K  [0201]  153.37,100.63 0 top
R21165  10K  [0201]  153.37,101.24 0 top
R21166  10K  [0201]  153.37,101.85 0 top
R21167  10K  [0201]  153.37,102.46 0 top
R21168  10K  [0201]  153.37,103.07 0 top
R21169  10K  [0201]  153.37,103.68 0 top
R21170  10K  [0201]  153.37,104.29 0 top
R21171  10K  [0201]  153.37,104.9 0 top
R21172  10K  [0201]  153.37,105.51 0 top
R21173  10K  [0201]  153.37,106.12 0 top
R21174  10K  [0201]  153.37,106.73 0 top
R21175  10K  [0201]  153.37,107.34 0 top
R21176  10K  [0201]  153.37,107.95 0 top
R21177  10K  [0201]  153.37,108.56 0 top
R21178  10K  [0201]  153.37,109.17 0 top
R21179  10K  [0201]  153.37,109.78 0 top
R21180  10K  [0201]  153.37,110.39 0 top
R21181  10K  [0201]  153.37,111 0 top
R21182  10K  [0201]  153.37,111.61 0 top
R21183  10K  [0201]  153.37,112.22 0 top
R21184  10K  [0201]  153.37,112.83 0 top
R21185  10K  [0201]  153.37,113.44 0 top
R21186  10K  [0201]  153.37,114.05 0 top
R21187  10K  [0201]  153.37,114.66 0 top
R21188  10K  [0201]  153.37,115.27 0 top
R21189  10K  [0201]  153.37,115.87 0 top
R21190  10K  [0201]  153.37,116.48 0 top
R21191  10K  [0201]  153.37,117.09 0 top
R21192  10K  [0201]  153.37,117.7 0 top
R21193  10K  [0201]  153.37,118.31 0 top
R21194  10K  [0201]  153.37,118.92 0 top
R21195  10K  [0201]  153.37,119.53 0 top
R21196  10K  [0201]  153.37,120.14 0 top
R21197  10K  [0201]  153.37,120.75 0 top
R21198  10K  [0201]  153.37,121.36 0 top
R21199  10K  [0201]  153.37,121.97 0 top
R21200  10K  [0201]  153.37,122.58 0 top
R21201  10K  [0201]  154.58,1.27 0 top
R21202  10K  [0201]  154.58,1.88 0 top
R21203  10K  [0201]  154.58,2.49 0 top
R21204  10K  [0201]  154.58,3.1 0 top
R21205  10K  [0201]  154.58,3.71 0 top
R21206  10K  [0201]  154.58,4.32 0 top
R21207  10K  [0201]  154.58,4.93 0 top
R21208  10K  [0201]  154.58,5.54 0 top
R21209  10K  [0201]  154.58,6.15 0 top
R21210  10K  [0201]  154.58,6.76 0 top
R21211  10K  [0201]  154.58,7.37 0 top
R21212  10K  [0201]  154.58,7.98 0 top
R21213  10K  [0201]  154.58,8.59 0 top
R21214  10K  [0201]  154.58,9.19 0 top
R21215  10K  [0201]  154.58,9.8 0 top
R21216  10K  [0201]  154.58,10.41 0 top
R21217  10K  [0201]  154.58,11.02 0 top
R21218  10K  [0201]  154.58,11.63 0 top
R21219  10K  [0201]  154.58,12.24 0 top
R21220  10K  [0201]  154.58,12.85 0 top
R21221  10K  [0201]  154.58,13.46 0 top
R21222  10K  [0201]  154.58,14.07 0 top
R21223  10K  [0201]  154.58,14.68 0 top
R21224  10K  [0201]  154.58,15.29 0 top
R21225  10K  [0201]  154.58,15.9 0 top
R21226  10K  [0201]  154.58,16.51 0 top
R21227  10K  [0201]  154.58,17.12 0 top
R21228  10K  [0201]  154.58,17.73 0 top
R21229  10K  [0201]  154.58,18.34 0 top
R21230  10K  [0201]  154.58,18.95 0 top
R21231  10K  [0201]  154.58,19.56 0 top
R21232  10K  [0201]  154.58,20.17 0 top
R21233  10K  [0201]  154.58,20.78 0 top
R21234  10K  [0201]  154.58,21.39 0 top
R21235  10K  [0201]  154.58,22 0 top
R21236  10K  [0201]  154.58,22.61 0 top
R21237  10K  [0201]  154.58,23.22 0 top
R21238  10K  [0201]  154.58,23.83 0 top
R21239  10K  [0201]  154.58,24.43 0 top
R21240  10K  [0201]  154.58,25.04 0 top
R21241  10K  [0201]  154.58,25.65 0 top
R21242  10K  [0201]  154.58,26.26 0 top
R21243  10K  [0201]  154.58,26.87 0 top
R21244  10K  [0201]  154.58,27.48 0 top
R21245  10K  [0201]  154.58,28.09 0 top
R21246  10K  [0201]  154.58,28.7 0 top
R21247  10K  [0201]  154.58,29.31 0 top
R21248  10K  [0201]  154.58,29.92 0 top
R21249  10K  [0201]  154.58,30.53 0 top
R21250  10K  [0201]  154.58,31.14 0 top
R21251  10K  [0201]  154.58,31.75 0 top
R21252  10K  [0201]  154.58,32.36 0 top
R21253  10K  [0201]  154.58,32.97 0 top
R21254  10K  [0201]  154.58,33.58 0 top
R21255  10K  [0201]  154.58,34.19 0 top
R21256  10K  [0201]  154.58,34.8 0 top
R21257  10K  [0201]  154.58,35.41 0 top
R21258  10K  [0201]  154.58,36.02 0 top
R21259  10K  [0201]  154.58,36.63 0 top
R21260  10K  [0201]  154.58,37.24 0 top
R21261  10K  [0201]  154.58,37.85 0 top
R21262  10K  [0201]  154.58,38.46 0 top
R21263  10K  [0201]  154.58,39.07 0 top
R21264  10K  [0201]  154.58,39.67 0 top
R21265  10K  [0201]  154.58,40.28 0 top
R21266  10K  [0201]  154.58,40.89 0 top
R21267  10K  [0201]  154.58,41.5 0 top
R21268  10K  [0201]  154.58,42.11 0 top
R21269  10K  [0201]  154.58,42.72 0 top
R21270  10K  [0201]  154.58,43.33 0 top
R21271  10K  [0201]  154.58,43.94 0 top
R21272  10K  [0201]  154.58,44.55 0 top
R21273  10K  [0201]  154.58,45.16 0 top
R21274  10K  [0201]  154.58,45.77 0 top
R21275  10K  [0201]  154.58,46.38 0 top
R21276  10K  [0201]  154.58,46.99 0 top
R21277  10K  [0201]  154.58,47.6 0 top
R21278  10K  [0201]  154.58,48.21 0 top
R21279  10K  [0201]  154.58,48.82 0 top
R21280  10K  [0201]  154.58,49.43 0 top
R21281  10K  [0201]  154.58,50.04 0 top
R21282  10K  [0201]  154.58,50.65 0 top
R21283  10K  [0201]  154.58,51.26 0 top
R21284  10K  [0201]  154.58,51.87 0 top
R21285  10K  [0201]  154.58,52.48 0 top
R21286  10K  [0201]  154.58,53.09 0 top
R21287  10K  [0201]  154.58,53.7 0 top
R21288  10K  [0201]  154.58,54.31 0 top
R21289  10K  [0201]  154.58,54.91 0 top
R21290  10K  [0201]  154.58,55.52 0 top
R21291  10K  [0201]  154.58,56.13 0 top
R21292  10K  [0201]  154.58,56.74 0 top
R21293  10K  [0201]  154.58,57.35 0 top
R21294  10K  [0201]  154.58,57.96 0 top
R21295  10K  [0201]  154.58,58.57 0 top
R21296  10K  [0201]  154.58,59.18 0 top
R21297  10K  [0201]  154.58,59.79 0 top
R21298  10K  [0201]  154.58,60.4 0 top
R21299  10K  [0201]  154.58,61.01 0 top
R21300  10K  [0201]  154.58,61.62 0 top
R21301  10K  [0201]  154.58,62.23 0 top
R21302  10K  [0201]  154.58,62.84 0 top
R21303  10K  [0201]  154.58,63.45 0 top
R21304  10K  [0201]  154.58,64.06 0 top
R21305  10K  [0201]  154.58,64.67 0 top
R21306  10K  [0201]  154.58,65.28 0 top
R21307  10K  [0201]  154.58,65.89 0 top
R21308  10K  [0201]  154.58,66.5 0 top
R21309  10K  [0201]  154.58,67.11 0 top
R21310  10K  [0201]  154.58,67.72 0 top
R21311  10K  [0201]  154.58,68.33 0 top
R21312  10K  [0201]  154.58,68.94 0 top
R21313  10K  [0201]  154.58,69.55 0 top
R21314  10K  [0201]  154.58,70.15 0 top
R21315  10K  [0201]  154.58,70.76 0 top
R21316  10K  [0201]  154.58,71.37 0 top
R21317  10K  [0201]  154.58,71.98 0 top
R21318  10K  [0201]  154.58,72.59 0 top
R21319  10K  [0201]  154.58,73.2 0 top
R21320  10K  [0201]  154.58,73.81 0 top
R21321  10K  [0201]  154.58,74.42 0 top
R21322  10K  [0201]  154.58,75.03 0 top
R21323  10K  [0201]  154.58,75.64 0 top
R21324  10K  [0201]  154.58,76.25 0 top
R21325  10K  [0201]  154.58,76.86 0 top
R21326  10K  [0201]  154.58,77.47 0 top
R21327  10K  [0201]  154.58,78.08 0 top
R21328  10K  [0201]  154.58,78.69 0 top
R21329  10K  [0201]  154.58,79.3 0 top
R21330  10K  [0201]  154.58,79.91 0 top
R21331  10K  [0201]  154.58,80.52 0 top
R21332  10K  [0201]  154.58,81.13 0 top
R21333  10K  [0201]  154.58,81.74 0 top
R21334  10K  [0201]  154.58,82.35 0 top
R21335  10K  [0201]  154.58,82.96 0 top
R21336  10K  [0201]  154.58,83.57 0 top
R21337  10K  [0201]  154.58,84.18 0 top
R21338  10K  [0201]  154.58,84.79 0 top
R21339  10K  [0201]  154.58,85.39 0 top
R21340  10K  [0201]  154.58,86 0 top
R21341  10K  [0201]  154.58,86.61 0 top
R21342  10K  [0201]  154.58,87.22 0 top
R21343  10K  [0201]  154.58,87.83 0 top
R21344  10K  [0201]  154.58,88.44 0 top
R21345  10K  [0201]  154.58,89.05 0 top
R21346  10K  [0201]  154.58,89.66 0 top
R21347  10K  [0201]  154.58,90.27 0 top
R21348  10K  [0201]  154.58,90.88 0 top
R21349  10K  [0201]  154.58,91.49 0 top
R21350  10K  [0201]  154.58,92.1 0 top
R21351  10K  [0201]  154.58,92.71 0 top
R21352  10K  [0201]  154.58,93.32 0 top
R21353  10K  [0201]  154.58,93.93 0 top
R21354  10K  [0201]  154.58,94.54 0 top
R21355  10K  [0201]  154.58,95.15 0 top
R21356  10K  [0201]  154.58,95.76 0 top
R21357  10K  [0201]  154.58,96.37 0 top
R21358  10K  [0201]  154.58,96.98 0 top
R21359  10K  [0201]  154.58,97.59 0 top
R21360  10K  [0201]  154.58,98.2 0 top
R21361  10K  [0201]  154.58,98.81 0 top
R21362  10K  [0201]  154.58,99.42 0 top
R21363  10K  [0201]  154.58,100.03 0 top
R21364  10K  [0201]  154.58,100.63 0 top
R21365  10K  [0201]  154.58,101.24 0 top
R21366  10K  [0201]  154.58,101.85 0 top
R21367  10K  [0201]  154.58,102.46 0 top
R21368  10K  [0201]  154.58,103.07 0 top
R21369  10K  [0201]  154.58,103.68 0 top
R21370  10K  [0201]  154.58,104.29 0 top
R21371  10K  [0201]  154.58,104.9 0 top
R21372  10K  [0201]  154.58,105.51 0 top
R21373  10K  [0201]  154.58,106.12 0 top
R21374  10K  [0201]  154.58,106.73 0 top
R21375  10K  [0201]  154.58,107.34 0 top
R21376  10K  [0201]  154.58,107.95 0 top
R21377  10K  [0201]  154.58,108.56 0 top
R21378  10K  [0201]  154.58,109.17 0 top
R21379  10K  [0201]  154.58,109.78 0 top
R21380  10K  [0201]  154.58,110.39 0 top
R21381  10K  [0201]  154.58,111 0 top
R21382  10K  [0201]  154.58,111.61 0 top
R21383  10K  [0201]  154.58,112.22 0 top
R21384  10K  [0201]  154.58,112.83 0 top
R21385  10K  [0201]  154.58,113.44 0 top
R21386  10K  [0201]  154.58,114.05 0 top
R21387  10K  [0201]  154.58,114.66 0 top
R21388  10K  [0201]  154.58,115.27 0 top
R21389  10K  [0201]  154.58,115.87 0 top
R21390  10K  [0201]  154.58,116.48 0 top
R21391  10K  [0201]  154.58,117.09 0 top
R21392  10K  [0201]  154.58,117.7 0 top
R21393  10K  [0201]  154.58,118.31 0 top
R21394  10K  [0201]  154.58,118.92 0 top
R21395  10K  [0201]  154.58,119.53 0 top
R21396  10K  [0201]  154.58,120.14 0 top
R21397  10K  [0201]  154.58,120.75 0 top
R21398  10K  [0201]  154.58,121.36 0 top
R21399  10K  [0201]  154.58,121.97 0 top
R21400  10K  [0201]  154.58,122.58 0 top
R21401  10K  [0201]  155.8,1.27 0 top
R21402  10K  [0201]  155.8,1.88 0 top
R21403  10K  [0201]  155.8,2.49 0 top
R21404  10K  [0201]  155.8,3.1 0 top
R21405  10K  [0201]  155.8,3.71 0 top
R21406  10K  [0201]  155.8,4.32 0 top
R21407  10K  [0201]  155.8,4.93 0 top
R21408  10K  [0201]  155.8,5.54 0 top
R21409  10K  [0201]  155.8,6.15 0 top
R21410  10K  [0201]  155.8,6.76 0 top
R21411  10K  [0201]  155.8,7.37 0 top
R21412  10K  [0201]  155.8,7.98 0 top
R21413  10K  [0201]  155.8,8.59 0 top
R21414  10K  [0201]  155.8,9.19 0 top
R21415  10K  [0201]  155.8,9.8 0 top
R21416  10K  [0201]  155.8,10.41 0 top
R21417  10K  [0201]  155.8,11.02 0 top
R21418  10K  [0201]  155.8,11.63 0 top
R21419  10K  [0201]  155.8,12.24 0 top
R21420  10K  [0201]  155.8,12.85 0 top
R21421  10K  [0201]  155.8,13.46 0 top
R21422  10K  [0201]  155.8,14.07 0 top
R21423  10K  [0201]  155.8,14.68 0 top
R21424  10K  [0201]  155.8,15.29 0 top
R21425  10K  [0201]  155.8,15.9 0 top
R21426  10K  [0201]  155.8,16.51 0 top
R21427  10K  [0201]  155.8,17.12 0 top
R21428  10K  [0201]  155.8,17.73 0 top
R21429  10K  [0201]  155.8,18.34 0 top
R21430  10K  [0201]  155.8,18.95 0 top
R21431  10K  [0201]  155.8,19.56 0 top
R21432  10K  [0201]  155.8,20.17 0 top
R21433  10K  [0201]  155.8,20.78 0 top
R21434  10K  [0201]  155.8,21.39 0 top
R21435  10K  [0201]  155.8,22 0 top
R21436  10K  [0201]  155.8,22.61 0 top
R21437  10K  [0201]  155.8,23.22 0 top
R21438  10K  [0201]  155.8,23.83 0 top
R21439  10K  [0201]  155.8,24.43 0 top
R21440  10K  [0201]  155.8,25.04 0 top
R21441  10K  [0201]  155.8,25.65 0 top
R21442  10K  [0201]  155.8,26.26 0 top
R21443  10K  [0201]  155.8,26.87 0 top
R21444  10K  [0201]  155.8,27.48 0 top
R21445  10K  [0201]  155.8,28.09 0 top
R21446  10K  [0201]  155.8,28.7 0 top
R21447  10K  [0201]  155.8,29.31 0 top
R21448  10K  [0201]  155.8,29.92 0 top
R21449  10K  [0201]  155.8,30.53 0 top
R21450  10K  [0201]  155.8,31.14 0 top
R21451  10K  [0201]  155.8,31.75 0 top
R21452  10K  [0201]  155.8,32.36 0 top
R21453  10K  [0201]  155.8,32.97 0 top
R21454  10K  [0201]  155.8,33.58 0 top
R21455  10K  [0201]  155.8,34.19 0 top
R21456  10K  [0201]  155.8,34.8 0 top
R21457  10K  [0201]  155.8,35.41 0 top
R21458  10K  [0201]  155.8,36.02 0 top
R21459  10K  [0201]  155.8,36.63 0 top
R21460  10K  [0201]  155.8,37.24 0 top
R21461  10K  [0201]  155.8,37.85 0 top
R21462  10K  [0201]  155.8,38.46 0 top
R21463  10K  [0201]  155.8,39.07 0 top
R21464  10K  [0201]  155.8,39.67 0 top
R21465  10K  [0201]  155.8,40.28 0 top
R21466  10K  [0201]  155.8,40.89 0 top
R21467  10K  [0201]  155.8,41.5 0 top
R21468  10K  [0201]  155.8,42.11 0 top
R21469  10K  [0201]  155.8,42.72 0 top
R21470  10K  [0201]  155.8,43.33 0 top
R21471  10K  [0201]  155.8,43.94 0 top
R21472  10K  [0201]  155.8,44.55 0 top
R21473  10K  [0201]  155.8,45.16 0 top
R21474  10K  [0201]  155.8,45.77 0 top
R21475  10K  [0201]  155.8,46.38 0 top
R21476  10K  [0201]  155.8,46.99 0 top
R21477  10K  [0201]  155.8,47.6 0 top
R21478  10K  [0201]  155.8,48.21 0 top
R21479  10K  [0201]  155.8,48.82 0 top
R21480  10K  [0201]  155.8,49.43 0 top
R21481  10K  [0201]  155.8,50.04 0 top
R21482  10K  [0201]  155.8,50.65 0 top
R21483  10K  [0201]  155.8,51.26 0 top
R21484  10K  [0201]  155.8,51.87 0 top
R21485  10K  [0201]  155.8,52.48 0 top
R21486  10K  [0201]  155.8,53.09 0 top
R21487  10K  [0201]  155.8,53.7 0 top
R21488  10K  [0201]  155.8,54.31 0 top
R21489  10K  [0201]  155.8,54.91 0 top
R21490  10K  [0201]  155.8,55.52 0 top
R21491  10K  [0201]  155.8,56.13 0 top
R21492  10K  [0201]  155.8,56.74 0 top
R21493  10K  [0201]  155.8,57.35 0 top
R21494  10K  [0201]  155.8,57.96 0 top
R21495  10K  [0201]  155.8,58.57 0 top
R21496  10K  [0201]  155.8,59.18 0 top
R21497  10K  [0201]  155.8,59.79 0 top
R21498  10K  [0201]  155.8,60.4 0 top
R21499  10K  [0201]  155.8,61.01 0 top
R21500  10K  [0201]  155.8,61.62 0 top
R21501  10K  [0201]  155.8,62.23 0 top
R21502  10K  [0201]  155.8,62.84 0 top
R21503  10K  [0201]  155.8,63.45 0 top
R21504  10K  [0201]  155.8,64.06 0 top
R21505  10K  [0201]  155.8,64.67 0 top
R21506  10K  [0201]  155.8,65.28 0 top
R21507  10K  [0201]  155.8,65.89 0 top
R21508  10K  [0201]  155.8,66.5 0 top
R21509  10K  [0201]  155.8,67.11 0 top
R21510  10K  [0201]  155.8,67.72 0 top
R21511  10K  [0201]  155.8,68.33 0 top
R21512  10K  [0201]  155.8,68.94 0 top
R21513  10K  [0201]  155.8,69.55 0 top
R21514  10K  [0201]  155.8,70.15 0 top
R21515  10K  [0201]  155.8,70.76 0 top
R21516  10K  [0201]  155.8,71.37 0 top
R21517  10K  [0201]  155.8,71.98 0 top
R21518  10K  [0201]  155.8,72.59 0 top
R21519  10K  [0201]  155.8,73.2 0 top
R21520  10K  [0201]  155.8,73.81 0 top
R21521  10K  [0201]  155.8,74.42 0 top
R21522  10K  [0201]  155.8,75.03 0 top
R21523  10K  [0201]  155.8,75.64 0 top
R21524  10K  [0201]  155.8,76.25 0 top
R21525  10K  [0201]  155.8,76.86 0 top
R21526  10K  [0201]  155.8,77.47 0 top
R21527  10K  [0201]  155.8,78.08 0 top
R21528  10K  [0201]  155.8,78.69 0 top
R21529  10K  [0201]  155.8,79.3 0 top
R21530  10K  [0201]  155.8,79.91 0 top
R21531  10K  [0201]  155.8,80.52 0 top
R21532  10K  [0201]  155.8,81.13 0 top
R21533  10K  [0201]  155.8,81.74 0 top
R21534  10K  [0201]  155.8,82.35 0 top
R21535  10K  [0201]  155.8,82.96 0 top
R21536  10K  [0201]  155.8,83.57 0 top
R21537  10K  [0201]  155.8,84.18 0 top
R21538  10K  [0201]  155.8,84.79 0 top
R21539  10K  [0201]  155.8,85.39 0 top
R21540  10K  [0201]  155.8,86 0 top
R21541  10K  [0201]  155.8,86.61 0 top
R21542  10K  [0201]  155.8,87.22 0 top
R21543  10K  [0201]  155.8,87.83 0 top
R21544  10K  [0201]  155.8,88.44 0 top
R21545  10K  [0201]  155.8,89.05 0 top
R21546  10K  [0201]  155.8,89.66 0 top
R21547  10K  [0201]  155.8,90.27 0 top
R21548  10K  [0201]  155.8,90.88 0 top
R21549  10K  [0201]  155.8,91.49 0 top
R21550  10K  [0201]  155.8,92.1 0 top
R21551  10K  [0201]  155.8,92.71 0 top
R21552  10K  [0201]  155.8,93.32 0 top
R21553  10K  [0201]  155.8,93.93 0 top
R21554  10K  [0201]  155.8,94.54 0 top
R21555  10K  [0201]  155.8,95.15 0 top
R21556  10K  [0201]  155.8,95.76 0 top
R21557  10K  [0201]  155.8,96.37 0 top
R21558  10K  [0201]  155.8,96.98 0 top
R21559  10K  [0201]  155.8,97.59 0 top
R21560  10K  [0201]  155.8,98.2 0 top
R21561  10K  [0201]  155.8,98.81 0 top
R21562  10K  [0201]  155.8,99.42 0 top
R21563  10K  [0201]  155.8,100.03 0 top
R21564  10K  [0201]  155.8,100.63 0 top
R21565  10K  [0201]  155.8,101.24 0 top
R21566  10K  [0201]  155.8,101.85 0 top
R21567  10K  [0201]  155.8,102.46 0 top
R21568  10K  [0201]  155.8,103.07 0 top
R21569  10K  [0201]  155.8,103.68 0 top
R21570  10K  [0201]  155.8,104.29 0 top
R21571  10K  [0201]  155.8,104.9 0 top
R21572  10K  [0201]  155.8,105.51 0 top
R21573  10K  [0201]  155.8,106.12 0 top
R21574  10K  [0201]  155.8,106.73 0 top
R21575  10K  [0201]  155.8,107.34 0 top
R21576  10K  [0201]  155.8,107.95 0 top
R21577  10K  [0201]  155.8,108.56 0 top
R21578  10K  [0201]  155.8,109.17 0 top
R21579  10K  [0201]  155.8,109.78 0 top
R21580  10K  [0201]  155.8,110.39 0 top
R21581  10K  [0201]  155.8,111 0 top
R21582  10K  [0201]  155.8,111.61 0 top
R21583  10K  [0201]  155.8,112.22 0 top
R21584  10K  [0201]  155.8,112.83 0 top
R21585  10K  [0201]  155.8,113.44 0 top
R21586  10K  [0201]  155.8,114.05 0 top
R21587  10K  [0201]  155.8,114.66 0 top
R21588  10K  [0201]  155.8,115.27 0 top
R21589  10K  [0201]  155.8,115.87 0 top
R21590  10K  [0201]  155.8,116.48 0 top
R21591  10K  [0201]  155.8,117.09 0 top
R21592  10K  [0201]  155.8,117.7 0 top
R21593  10K  [0201]  155.8,118.31 0 top
R21594  10K  [0201]  155.8,118.92 0 top
R21595  10K  [0201]  155.8,119.53 0 top
R21596  10K  [0201]  155.8,120.14 0 top
R21597  10K  [0201]  155.8,120.75 0 top
R21598  10K  [0201]  155.8,121.36 0 top
R21599  10K  [0201]  155.8,121.97 0 top
R21600  10K  [0201]  155.8,122.58 0 top
R21601  10K  [0201]  157.02,1.27 0 top
R21602  10K  [0201]  157.02,1.88 0 top
R21603  10K  [0201]  157.02,2.49 0 top
R21604  10K  [0201]  157.02,3.1 0 top
R21605  10K  [0201]  157.02,3.71 0 top
R21606  10K  [0201]  157.02,4.32 0 top
R21607  10K  [0201]  157.02,4.93 0 top
R21608  10K  [0201]  157.02,5.54 0 top
R21609  10K  [0201]  157.02,6.15 0 top
R21610  10K  [0201]  157.02,6.76 0 top
R21611  10K  [0201]  157.02,7.37 0 top
R21612  10K  [0201]  157.02,7.98 0 top
R21613  10K  [0201]  157.02,8.59 0 top
R21614  10K  [0201]  157.02,9.19 0 top
R21615  10K  [0201]  157.02,9.8 0 top
R21616  10K  [0201]  157.02,10.41 0 top
R21617  10K  [0201]  157.02,11.02 0 top
R21618  10K  [0201]  157.02,11.63 0 top
R21619  10K  [0201]  157.02,12.24 0 top
R21620  10K  [0201]  157.02,12.85 0 top
R21621  10K  [0201]  157.02,13.46 0 top
R21622  10K  [0201]  157.02,14.07 0 top
R21623  10K  [0201]  157.02,14.68 0 top
R21624  10K  [0201]  157.02,15.29 0 top
R21625  10K  [0201]  157.02,15.9 0 top
R21626  10K  [0201]  157.02,16.51 0 top
R21627  10K  [0201]  157.02,17.12 0 top
R21628  10K  [0201]  157.02,17.73 0 top
R21629  10K  [0201]  157.02,18.34 0 top
R21630  10K  [0201]  157.02,18.95 0 top
R21631  10K  [0201]  157.02,19.56 0 top
R21632  10K  [0201]  157.02,20.17 0 top
R21633  10K  [0201]  157.02,20.78 0 top
R21634  10K  [0201]  157.02,21.39 0 top
R21635  10K  [0201]  157.02,22 0 top
R21636  10K  [0201]  157.02,22.61 0 top
R21637  10K  [0201]  157.02,23.22 0 top
R21638  10K  [0201]  157.02,23.83 0 top
R21639  10K  [0201]  157.02,24.43 0 top
R21640  10K  [0201]  157.02,25.04 0 top
R21641  10K  [0201]  157.02,25.65 0 top
R21642  10K  [0201]  157.02,26.26 0 top
R21643  10K  [0201]  157.02,26.87 0 top
R21644  10K  [0201]  157.02,27.48 0 top
R21645  10K  [0201]  157.02,28.09 0 top
R21646  10K  [0201]  157.02,28.7 0 top
R21647  10K  [0201]  157.02,29.31 0 top
R21648  10K  [0201]  157.02,29.92 0 top
R21649  10K  [0201]  157.02,30.53 0 top
R21650  10K  [0201]  157.02,31.14 0 top
R21651  10K  [0201]  157.02,31.75 0 top
R21652  10K  [0201]  157.02,32.36 0 top
R21653  10K  [0201]  157.02,32.97 0 top
R21654  10K  [0201]  157.02,33.58 0 top
R21655  10K  [0201]  157.02,34.19 0 top
R21656  10K  [0201]  157.02,34.8 0 top
R21657  10K  [0201]  157.02,35.41 0 top
R21658  10K  [0201]  157.02,36.02 0 top
R21659  10K  [0201]  157.02,36.63 0 top
R21660  10K  [0201]  157.02,37.24 0 top
R21661  10K  [0201]  157.02,37.85 0 top
R21662  10K  [0201]  157.02,38.46 0 top
R21663  10K  [0201]  157.02,39.07 0 top
R21664  10K  [0201]  157.02,39.67 0 top
R21665  10K  [0201]  157.02,40.28 0 top
R21666  10K  [0201]  157.02,40.89 0 top
R21667  10K  [0201]  157.02,41.5 0 top
R21668  10K  [0201]  157.02,42.11 0 top
R21669  10K  [0201]  157.02,42.72 0 top
R21670  10K  [0201]  157.02,43.33 0 top
R21671  10K  [0201]  157.02,43.94 0 top
R21672  10K  [0201]  157.02,44.55 0 top
R21673  10K  [0201]  157.02,45.16 0 top
R21674  10K  [0201]  157.02,45.77 0 top
R21675  10K  [0201]  157.02,46.38 0 top
R21676  10K  [0201]  157.02,46.99 0 top
R21677  10K  [0201]  157.02,47.6 0 top
R21678  10K  [0201]  157.02,48.21 0 top
R21679  10K  [0201]  157.02,48.82 0 top
R21680  10K  [0201]  157.02,49.43 0 top
R21681  10K  [0201]  157.02,50.04 0 top
R21682  10K  [0201]  157.02,50.65 0 top
R21683  10K  [0201]  157.02,51.26 0 top
R21684  10K  [0201]  157.02,51.87 0 top
R21685  10K  [0201]  157.02,52.48 0 top
R21686  10K  [0201]  157.02,53.09 0 top
R21687  10K  [0201]  157.02,53.7 0 top
R21688  10K  [0201]  157.02,54.31 0 top
R21689  10K  [0201]  157.02,54.91 0 top
R21690  10K  [0201]  157.02,55.52 0 top
R21691  10K  [0201]  157.02,56.13 0 top
R21692  10K  [0201]  157.02,56.74 0 top
R21693  10K  [0201]  157.02,57.35 0 top
R21694  10K  [0201]  157.02,57.96 0 top
R21695  10K  [0201]  157.02,58.57 0 top
R21696  10K  [0201]  157.02,59.18 0 top
R21697  10K  [0201]  157.02,59.79 0 top
R21698  10K  [0201]  157.02,60.4 0 top
R21699  10K  [0201]  157.02,61.01 0 top
R21700  10K  [0201]  157.02,61.62 0 top
R21701  10K  [0201]  157.02,62.23 0 top
R21702  10K  [0201]  157.02,62.84 0 top
R21703  10K  [0201]  157.02,63.45 0 top
R21704  10K  [0201]  157.02,64.06 0 top
R21705  10K  [0201]  157.02,64.67 0 top
R21706  10K  [0201]  157.02,65.28 0 top
R21707  10K  [0201]  157.02,65.89 0 top
R21708  10K  [0201]  157.02,66.5 0 top
R21709  10K  [0201]  157.02,67.11 0 top
R21710  10K  [0201]  157.02,67.72 0 top
R21711  10K  [0201]  157.02,68.33 0 top
R21712  10K  [0201]  157.02,68.94 0 top
R21713  10K  [0201]  157.02,69.55 0 top
R21714  10K  [0201]  157.02,70.15 0 top
R21715  10K  [0201]  157.02,70.76 0 top
R21716  10K  [0201]  157.02,71.37 0 top
R21717  10K  [0201]  157.02,71.98 0 top
R21718  10K  [0201]  157.02,72.59 0 top
R21719  10K  [0201]  157.02,73.2 0 top
R21720  10K  [0201]  157.02,73.81 0 top
R21721  10K  [0201]  157.02,74.42 0 top
R21722  10K  [0201]  157.02,75.03 0 top
R21723  10K  [0201]  157.02,75.64 0 top
R21724  10K  [0201]  157.02,76.25 0 top
R21725  10K  [0201]  157.02,76.86 0 top
R21726  10K  [0201]  157.02,77.47 0 top
R21727  10K  [0201]  157.02,78.08 0 top
R21728  10K  [0201]  157.02,78.69 0 top
R21729  10K  [0201]  157.02,79.3 0 top